# Altium schematic sheet mainboard.schdoc (part 1 of 2)
size A0; Organization: Protel International P/L; Address1: L3, 12a Rodborough Rd; Address2: Frenchs Forest; Address3: NSW; Address4: Australia 2086
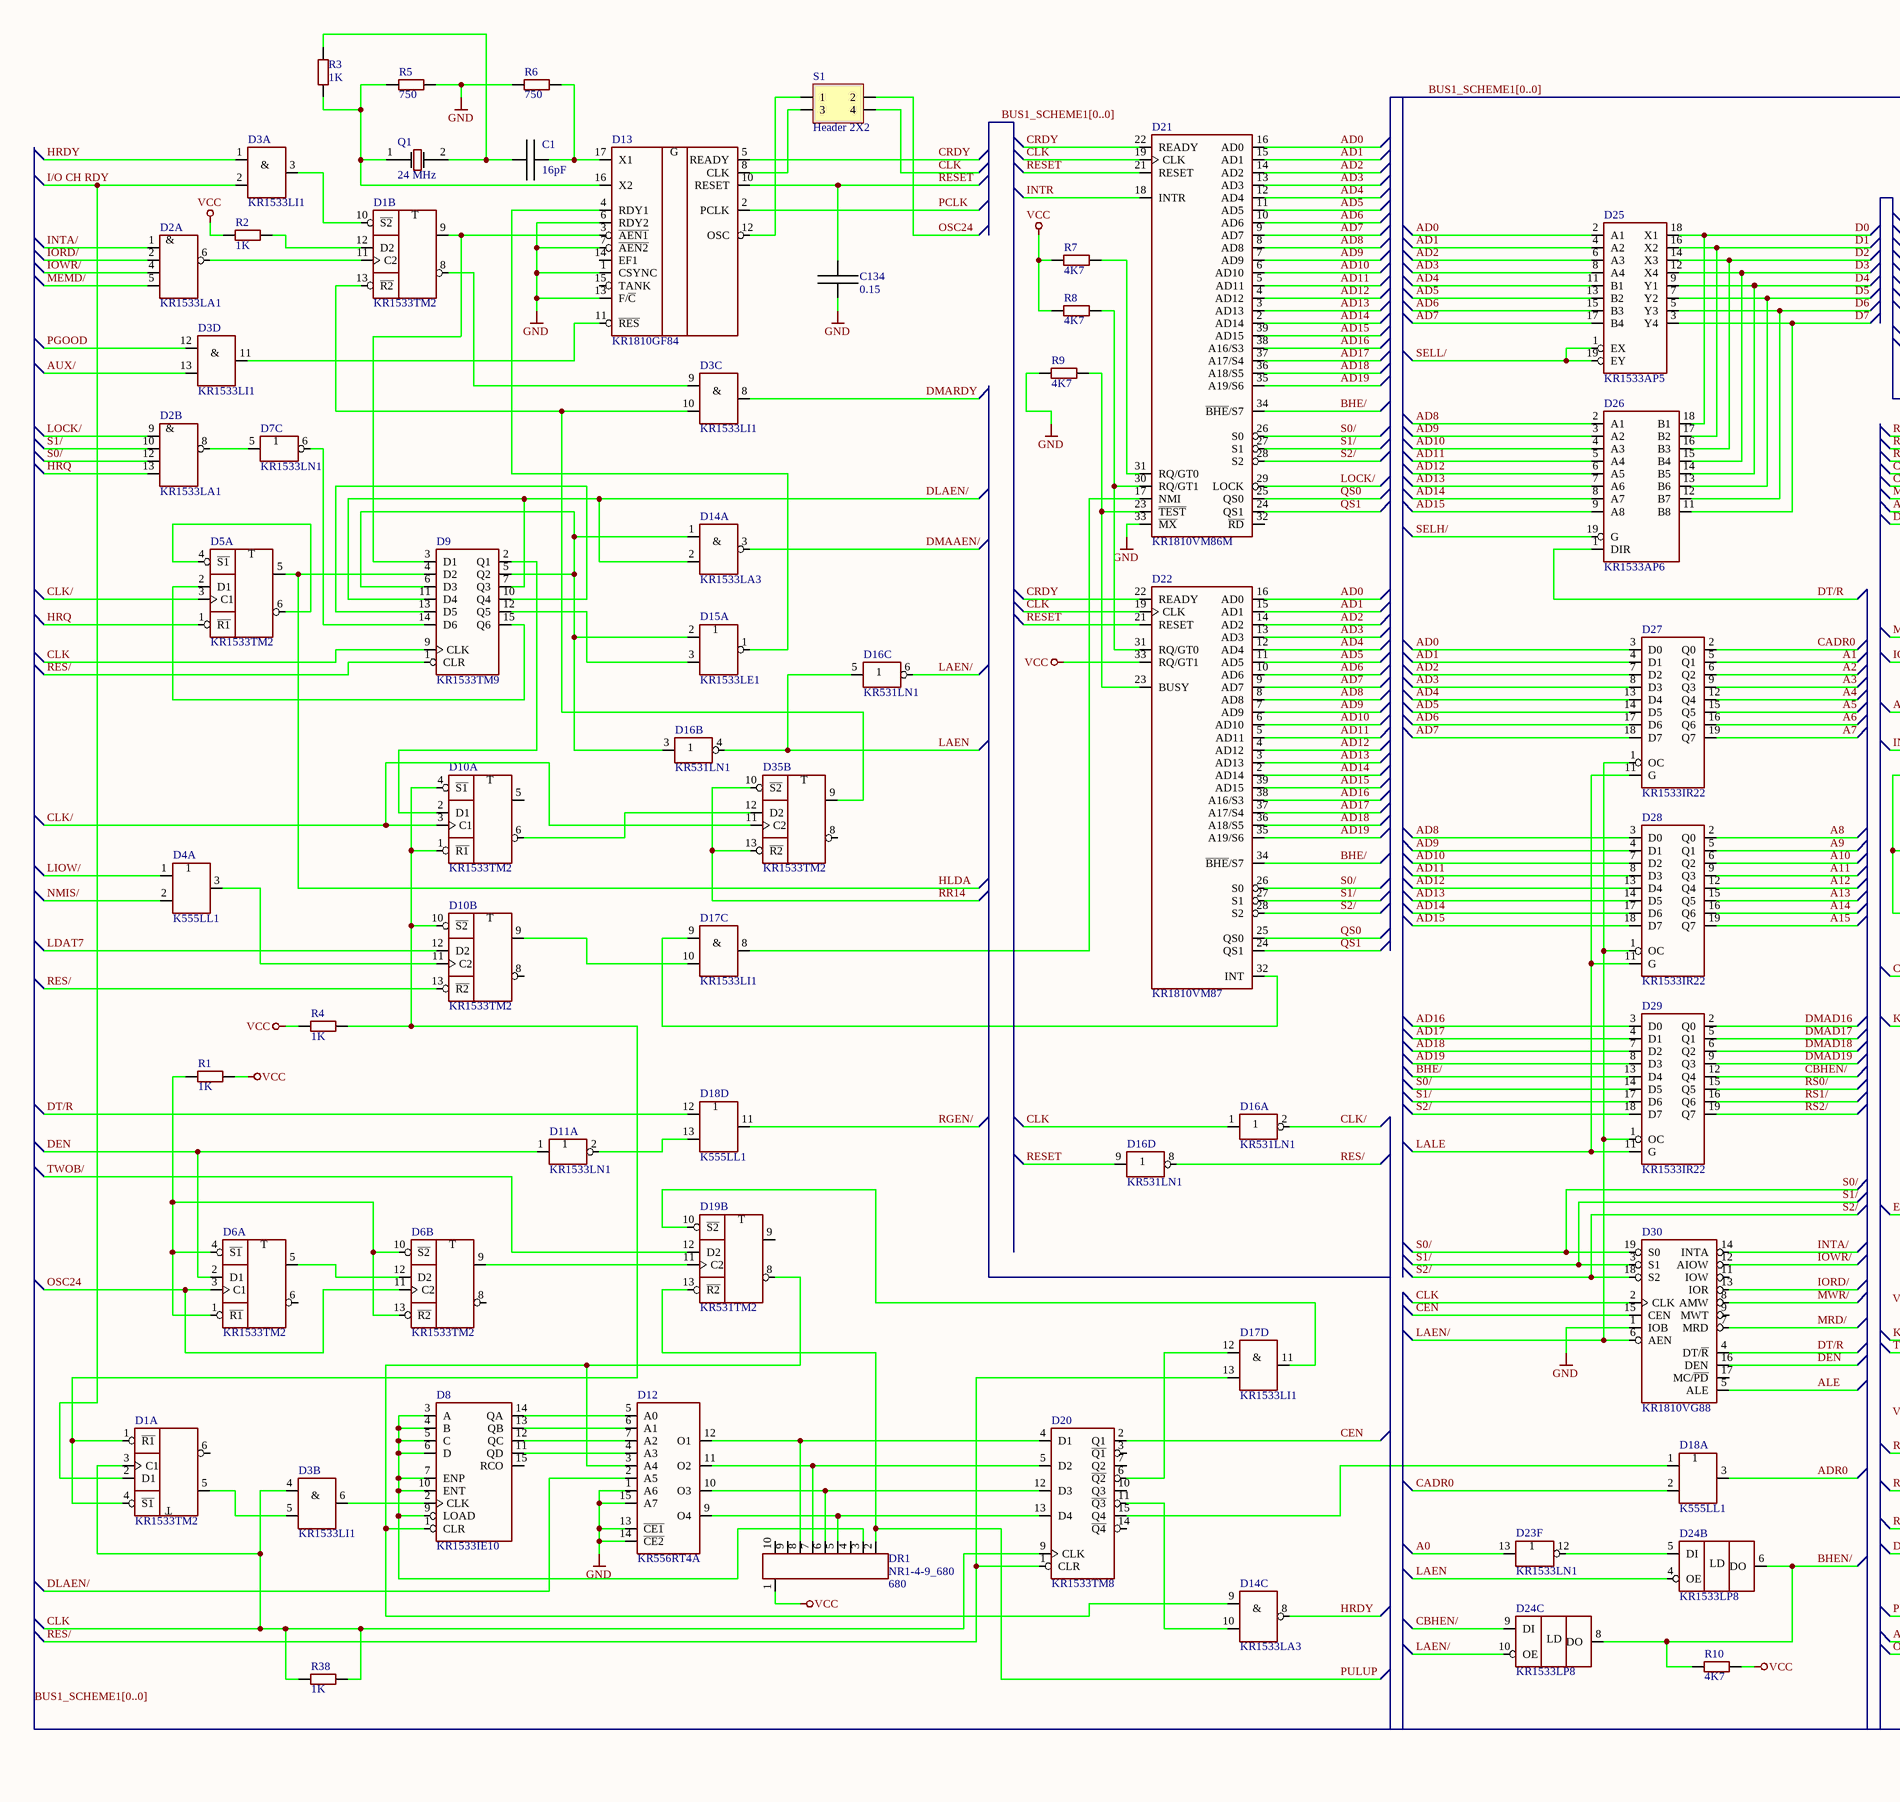
[diagram p0: mainboard.schdoc, top left]
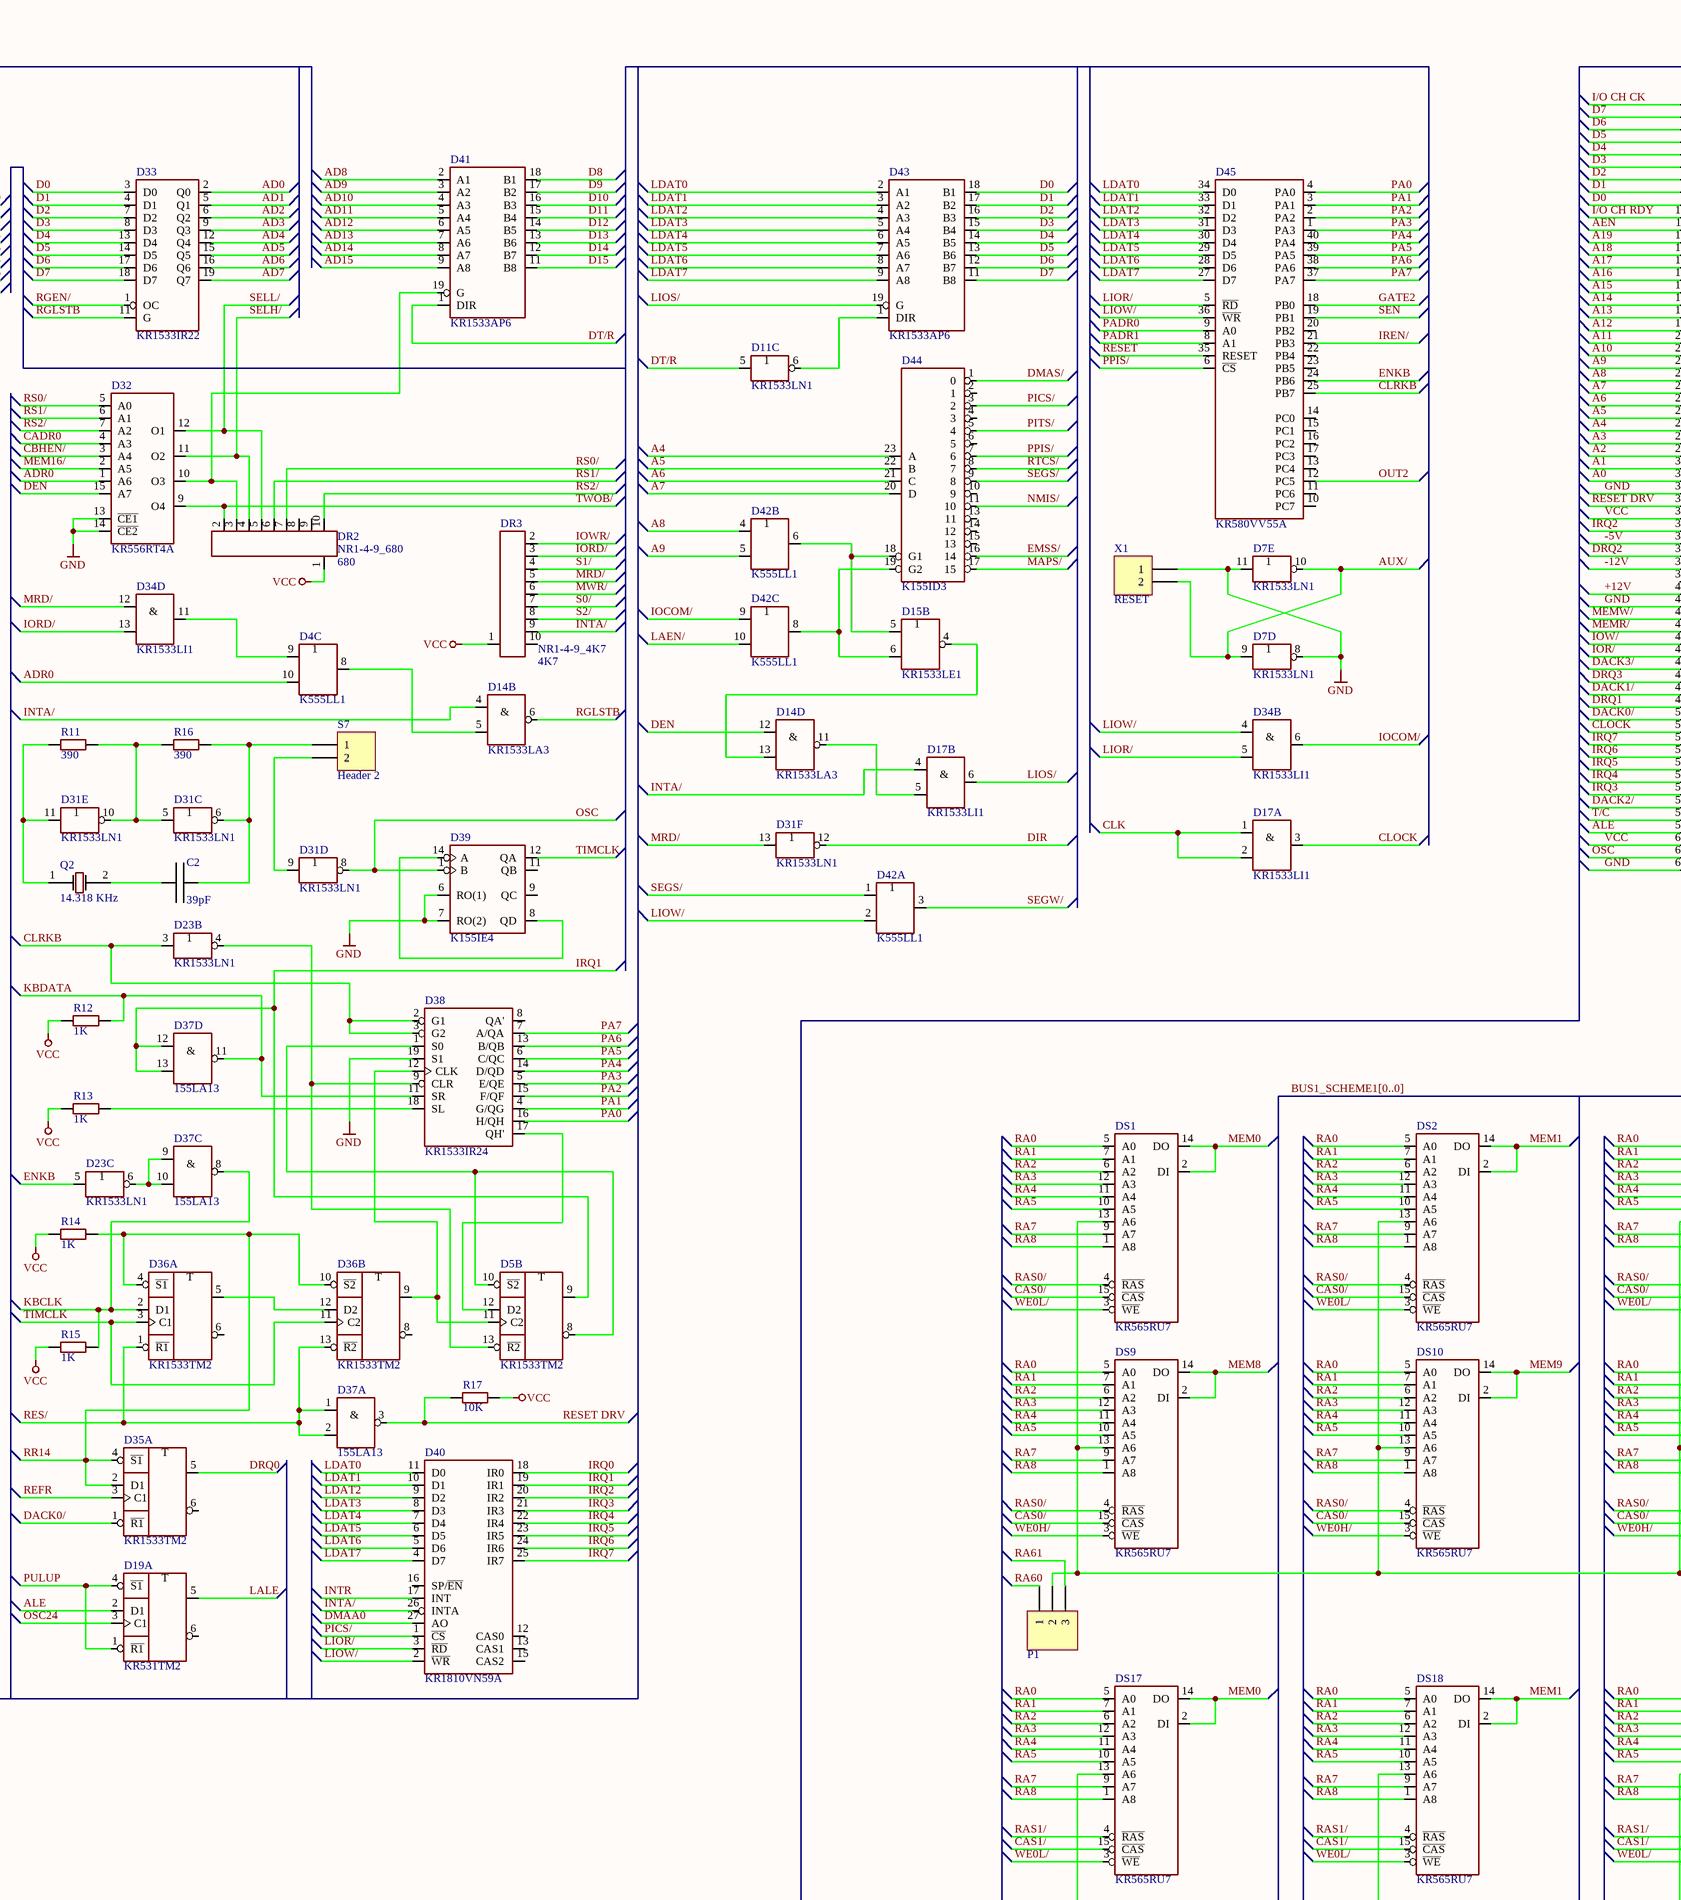
[diagram p1: mainboard.schdoc, top middle]
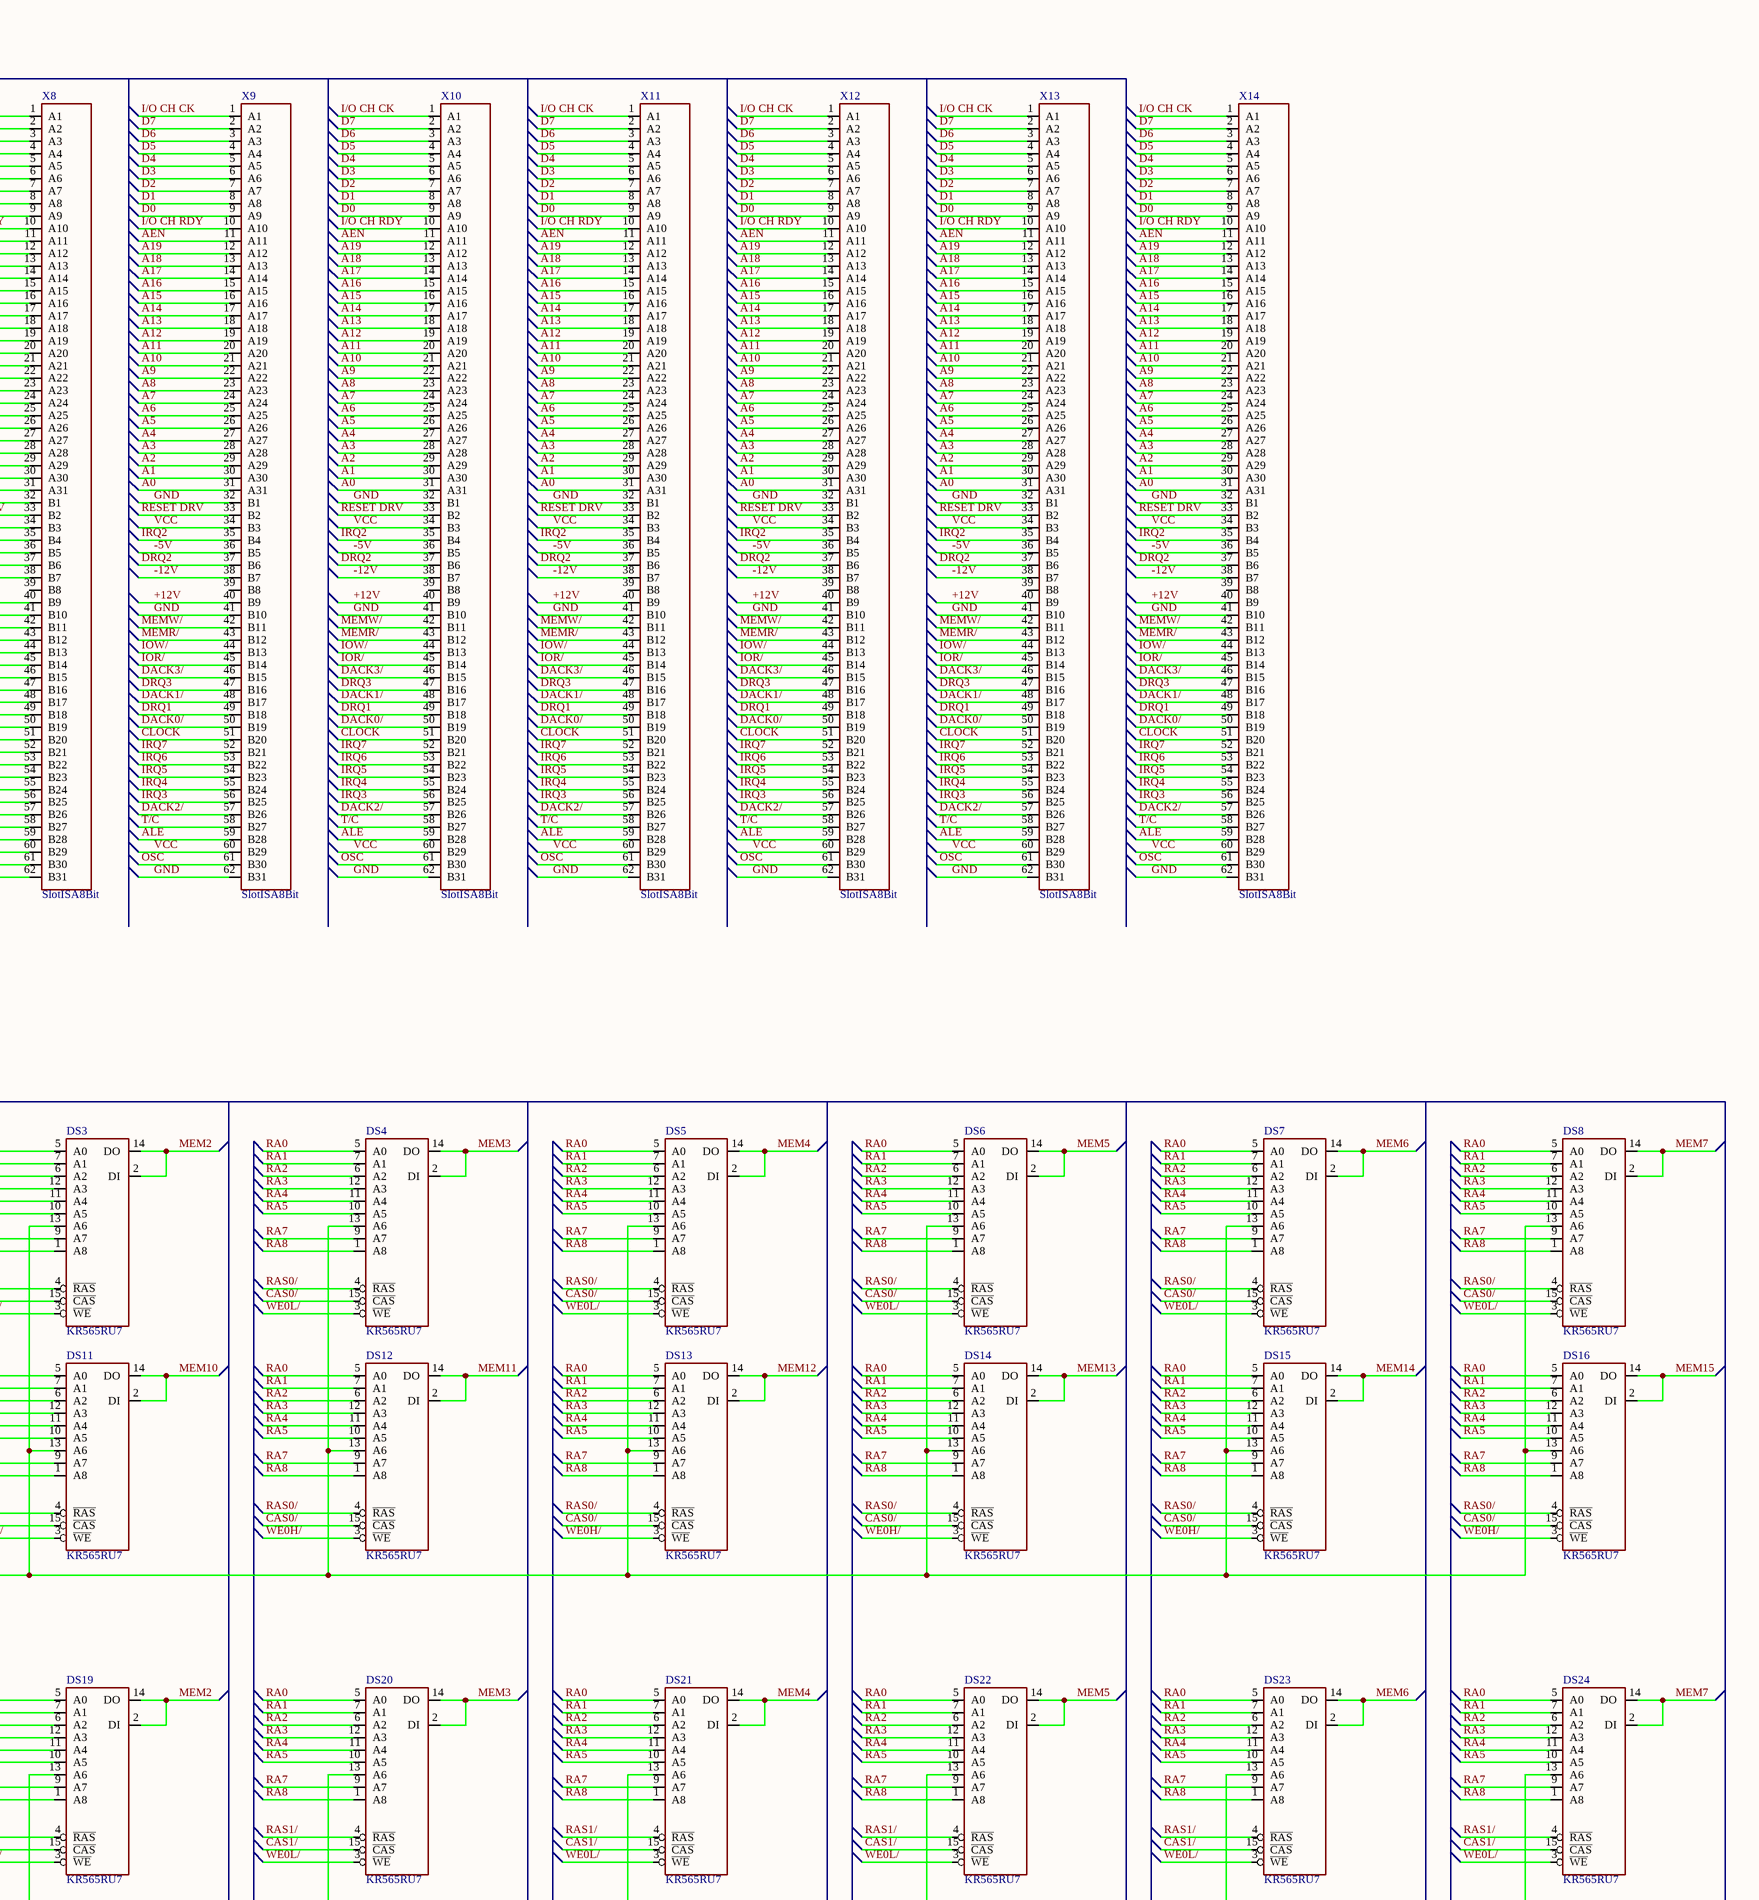
[diagram p2: mainboard.schdoc, top right]
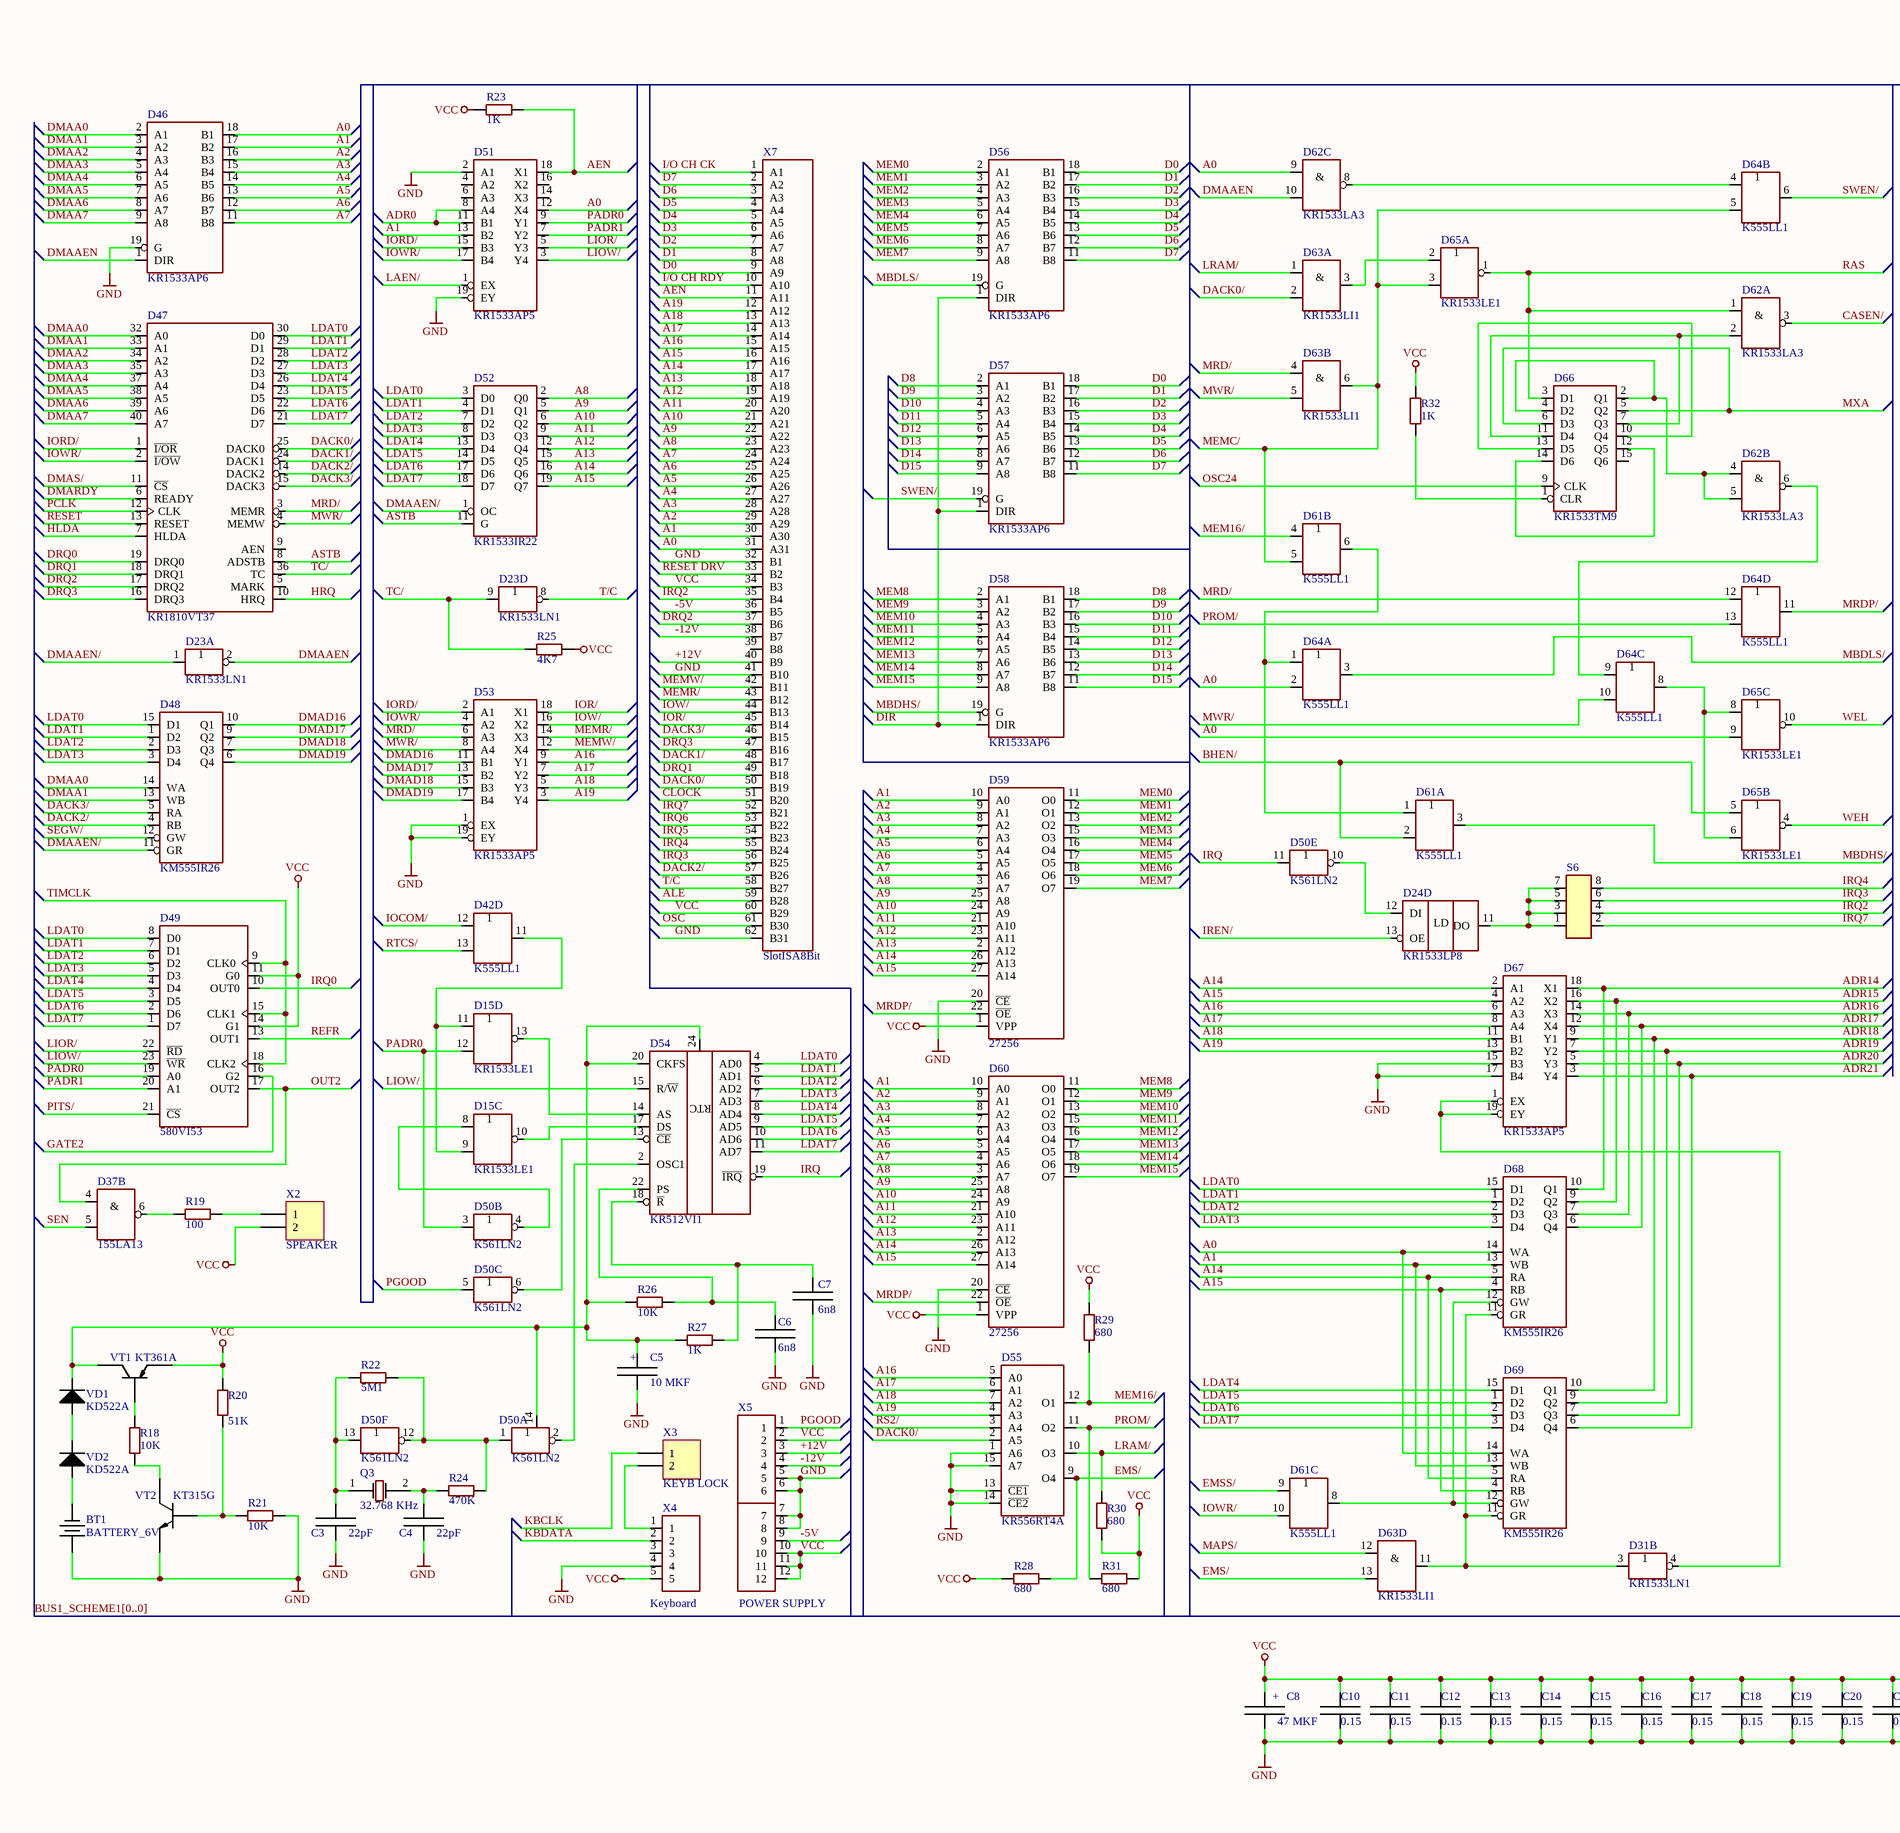
[diagram p3: mainboard.schdoc, bottom left]